# EAGLE schematic LG08.v1.0.2 (EAGLE 7.5.0)

## Sheet 1 of 6
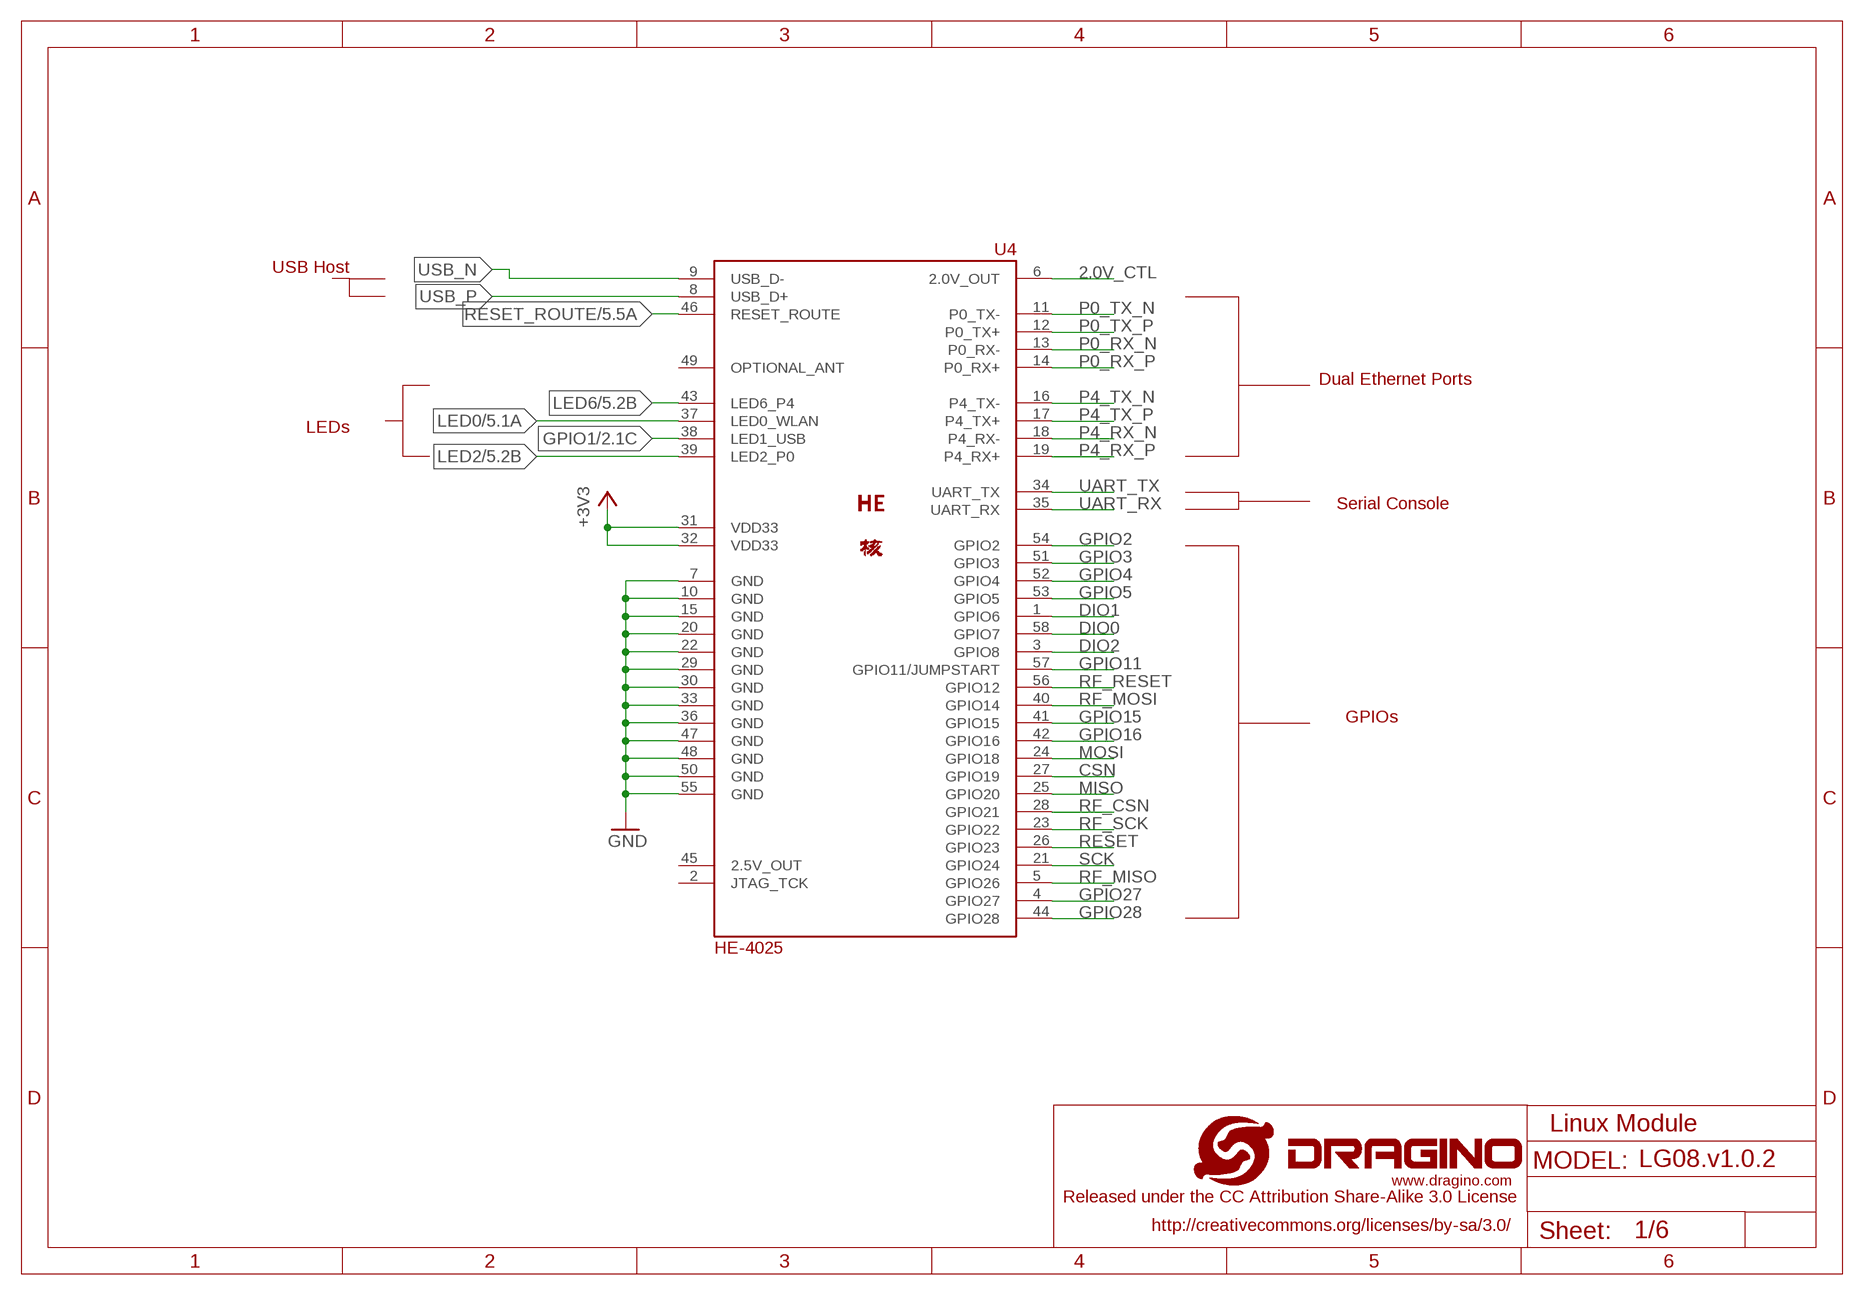
[diagram p0: schematic, sheet 1]

### Parts
U4  HE-4025  [HE-4025]

### Nets
2.0V_CTL: U4.6(2.0V_OUT) ; also sheet 4
+3V3: U4.31(VDD33) U4.32(VDD33) ; also sheet 2,4,5,6
CSN: U4.27(GPIO19) ; also sheet 5
DIO0: U4.58(GPIO7) ; also sheet 6
DIO1: U4.1(GPIO6) ; also sheet 6
DIO2: U4.3(GPIO8) ; also sheet 6
GND [gnd]: U4.7(GND) U4.10(GND) U4.15(GND) U4.20(GND) U4.22(GND) U4.29(GND) U4.30(GND) U4.33(GND) U4.36(GND) U4.47(GND) U4.48(GND) U4.50(GND) U4.55(GND) ; also sheet 2,3,4,5,6
GPIO1: U4.38(LED1_USB) ; also sheet 2
GPIO2: U4.54(GPIO2)
GPIO3: U4.51(GPIO3)
GPIO4: U4.52(GPIO4)
GPIO5: U4.53(GPIO5)
GPIO11: U4.57(GPIO11/JUMPSTART) ; also sheet 5
GPIO15: U4.41(GPIO15) ; also sheet 3
GPIO16: U4.42(GPIO16) ; also sheet 5
GPIO27: U4.4(GPIO27) ; also sheet 5
GPIO28: U4.44(GPIO28) ; also sheet 5
LED0: U4.37(LED0_WLAN) ; also sheet 5
LED2: U4.39(LED2_P0) ; also sheet 5
LED6: U4.43(LED6_P4) ; also sheet 5
MISO: U4.25(GPIO20) ; also sheet 5
MOSI: U4.24(GPIO18) ; also sheet 5
P0_RX_N: U4.13(P0_RX-) ; also sheet 4
P0_RX_P: U4.14(P0_RX+) ; also sheet 4
P0_TX_N: U4.11(P0_TX-) ; also sheet 4
P0_TX_P: U4.12(P0_TX+) ; also sheet 4
P4_RX_N: U4.18(P4_RX-) ; also sheet 4
P4_RX_P: U4.19(P4_RX+) ; also sheet 4
P4_TX_N: U4.16(P4_TX-) ; also sheet 4
P4_TX_P: U4.17(P4_TX+) ; also sheet 4
RESET: U4.26(GPIO23) ; also sheet 5
RESET_ROUTE: U4.46(RESET_ROUTE) ; also sheet 5
RF_CSN: U4.28(GPIO21) ; also sheet 6
RF_MISO: U4.5(GPIO26) ; also sheet 6
RF_MOSI: U4.40(GPIO14) ; also sheet 6
RF_RESET: U4.56(GPIO12) ; also sheet 6
RF_SCK: U4.23(GPIO22) ; also sheet 6
SCK: U4.21(GPIO24) ; also sheet 5
UART_RX: U4.35(UART_RX) ; also sheet 4
UART_TX: U4.34(UART_TX) ; also sheet 4
USB_N: U4.9(USB_D-) ; also sheet 6
USB_P: U4.8(USB_D+) ; also sheet 6
Unconnected: U4.2(JTAG_TCK) U4.45(2.5V_OUT)

### Notes on the sheet
- USB Host
- Dual Ethernet Ports
- LEDs
- Serial Console
- GPIOs
- Linux Module

## Sheet 2 of 6
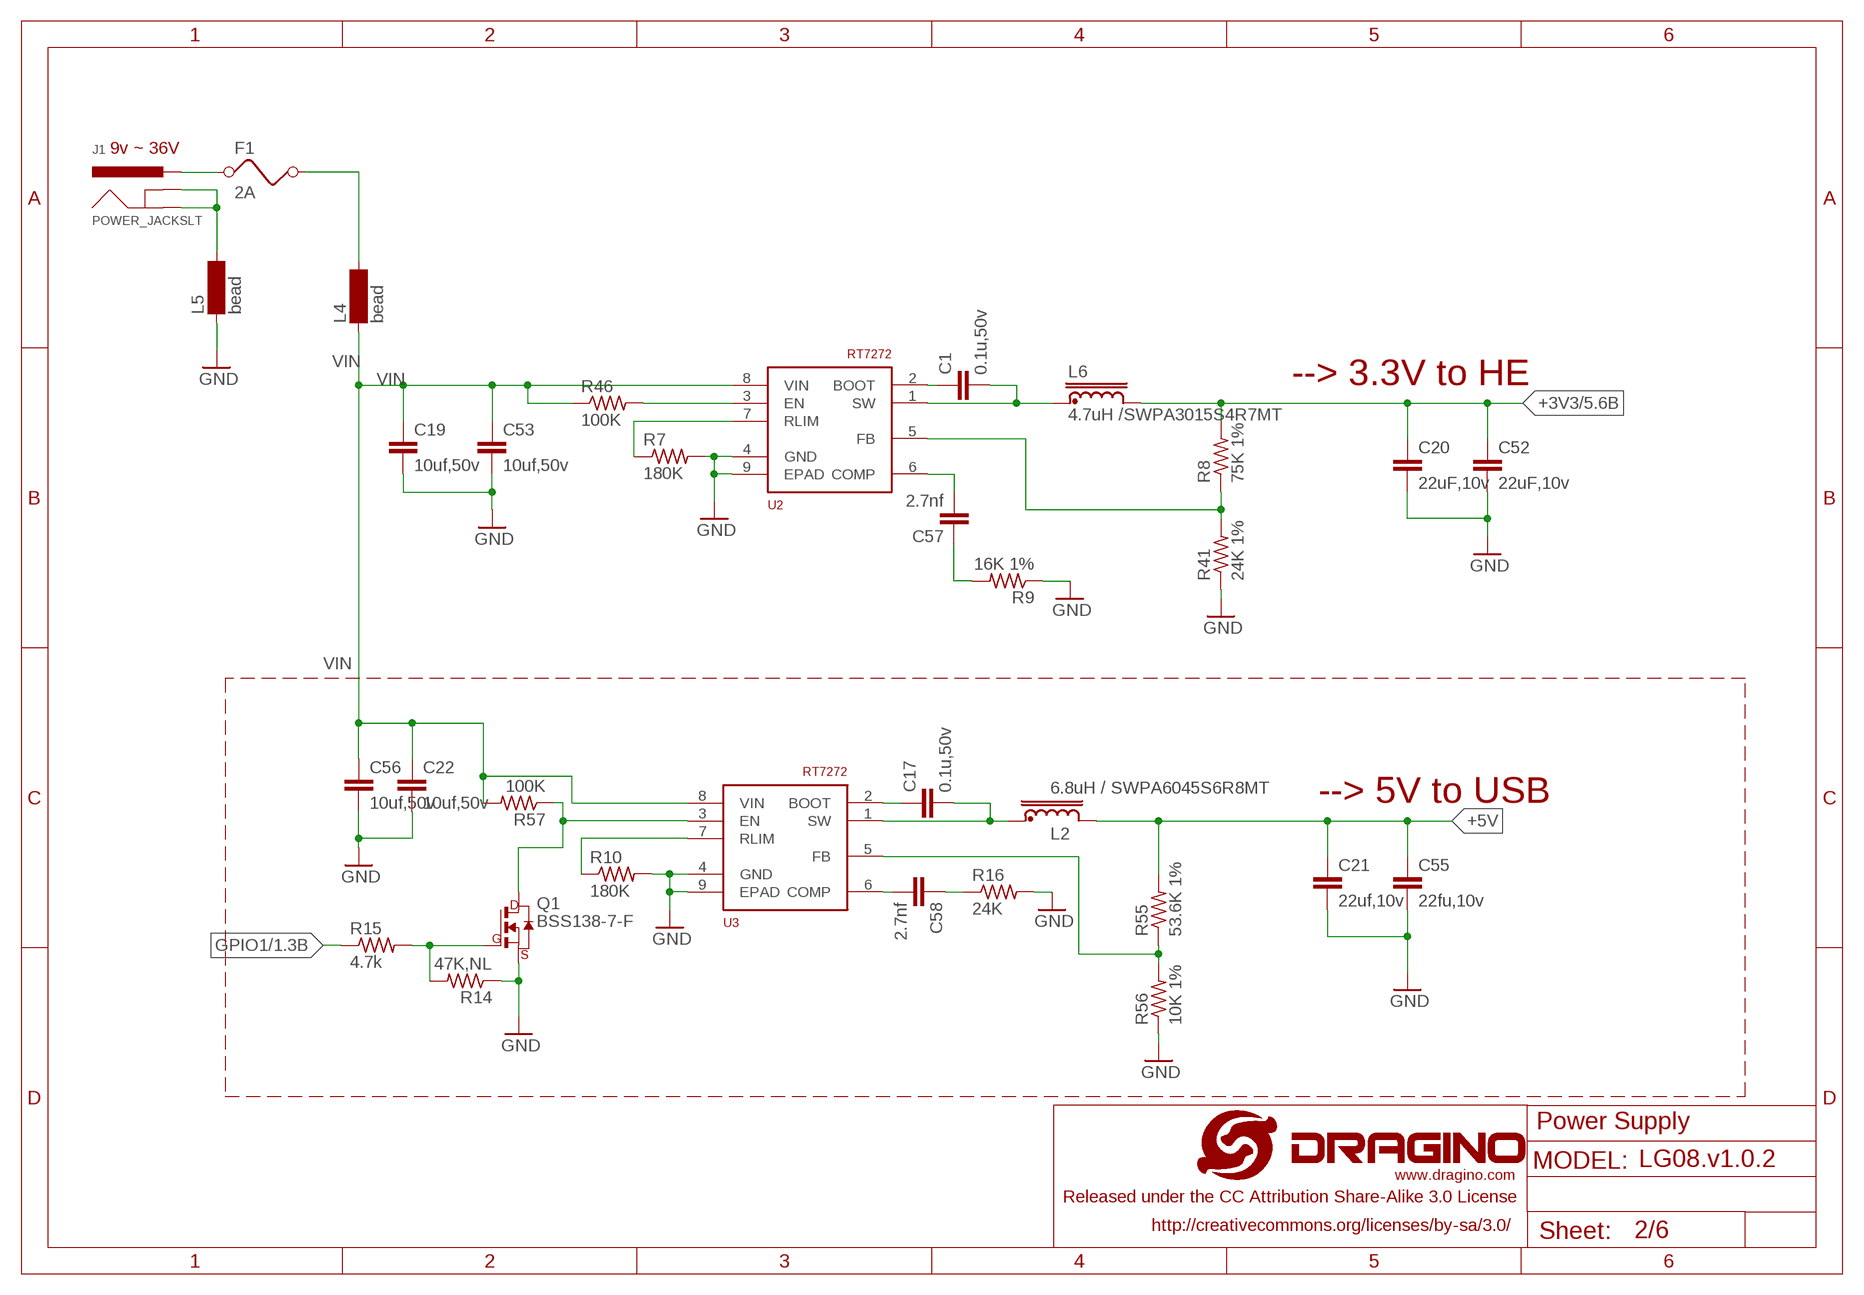
[diagram p1: schematic, sheet 2]

### Parts
C1  0.1u,50v  C-EUC0402  [C0402]
C17  0.1u,50v  C-EUC0402  [C0402]
C19  10uf,50v  C-EUC1206K  [C1206K]
C20  22uF,10v  C-EUC1210  [C1210]
C21  22uf,10v  C-EUC1210  [C1210]
C22  10uf,50v  C-EUC1206K  [C1206K]
C52  22uF,10v  C-EUC1210  [C1210]
C53  10uf,50v  C-EUC1206K  [C1206K]
C55  22fu,10v  C-EUC1210  [C1210]
C56  10uf,50v  C-EUC1206K  [C1206K]
C57  2.7nf  C-EUC0402  [C0402]
C58  2.7nf  C-EUC0402  [C0402]
F1  2A  FUSE1812  [L1812]
J1  POWER_JACKSLT  [POWER_JACK_SLOT]
L2  6.8uH / SWPA6045S6R8MT  INDUCTOR6028S  [SWPA6028S]
L4  bead  BS11  [BS11]
L5  bead  BS11  [BS11]
L6  4.7uH /SWPA3015S4R7MT  INDUCTORSWPA3010S  [SWPA3010S]
Q1  BSS138-7-F  NMOSFET  [SOT-23]
R7  180K  R-US_R0402  [R0402]
R8  75K 1%  R-US_R0402  [R0402]
R9  16K 1%  R-US_R0402  [R0402]
R10  180K  R-US_R0402  [R0402]
R14  47K,NL  R-US_R0402  [R0402]
R15  4.7k  R-US_R0402  [R0402]
R16  24K  R-US_R0402  [R0402]
R41  24K 1%  R-US_R0402  [R0402]
R46  100K  R-US_R0402  [R0402]
R55  53.6K 1%  R-US_R0402  [R0402]
R56  10K 1%  R-US_R0402  [R0402]
R57  100K  R-US_R0402  [R0402]
U2  RT7272  [RT8250-SOP8]
U3  RT7272  [RT8250-SOP8]

### Nets
+3V3: C20.1 C52.1 L6.P$2 R8.2 ; also sheet 1,4,5,6
+5V: C21.1 C55.1 L2.P$2 R55.2 ; also sheet 4,5,6
GND [gnd]: C19.2 C20.2 C21.2 C22.2 C52.2 C53.2 C55.2 C56.2 L5.1 Q1.2(S) R7.2 R9.1 R10.2 R14.1 R16.2 R41.1 R56.1 U2.4(GND) U2.9(EPAD) U3.4(GND) U3.9(EPAD) ; also sheet 1,3,4,5,6
GPIO1: R15.1 ; also sheet 1
N$2: J1.GND@1(GNDBREAK) J1.GND@2(GND) L5.2
N$3: F1.2 L4.2
N$12: F1.1 J1.PWR
N$16: Q1.1(D) R57.1 U3.3(EN)
N$17: R10.1 U3.7(RLIM)
N$19: Q1.3(G) R14.2 R15.2
N$20: C58.2 U3.6(COMP)
N$22 [gnd]: R55.1 R56.2 U3.5(FB)
N$24: C1.2 L6.P$1 U2.1(SW)
N$25: R46.2 U2.3(EN)
N$26: R7.1 U2.7(RLIM)
N$27: C1.1 U2.2(BOOT)
N$29: C57.1 R9.2
N$31: C57.2 U2.6(COMP)
N$32: C58.1 R16.1
N$34: C17.2 L2.P$1 U3.1(SW)
N$49: R8.1 R41.2 U2.5(FB)
N$55: C17.1 U3.2(BOOT)
VIN: C19.1 C22.1 C53.1 C56.1 L4.1 R46.1 R57.2 U2.8(VIN) U3.8(VIN) ; also sheet 3

### Notes on the sheet
- 9v ~ 36V
- --> 3.3V to HE
- --> 5V to USB
- Power Supply

## Sheet 3 of 6
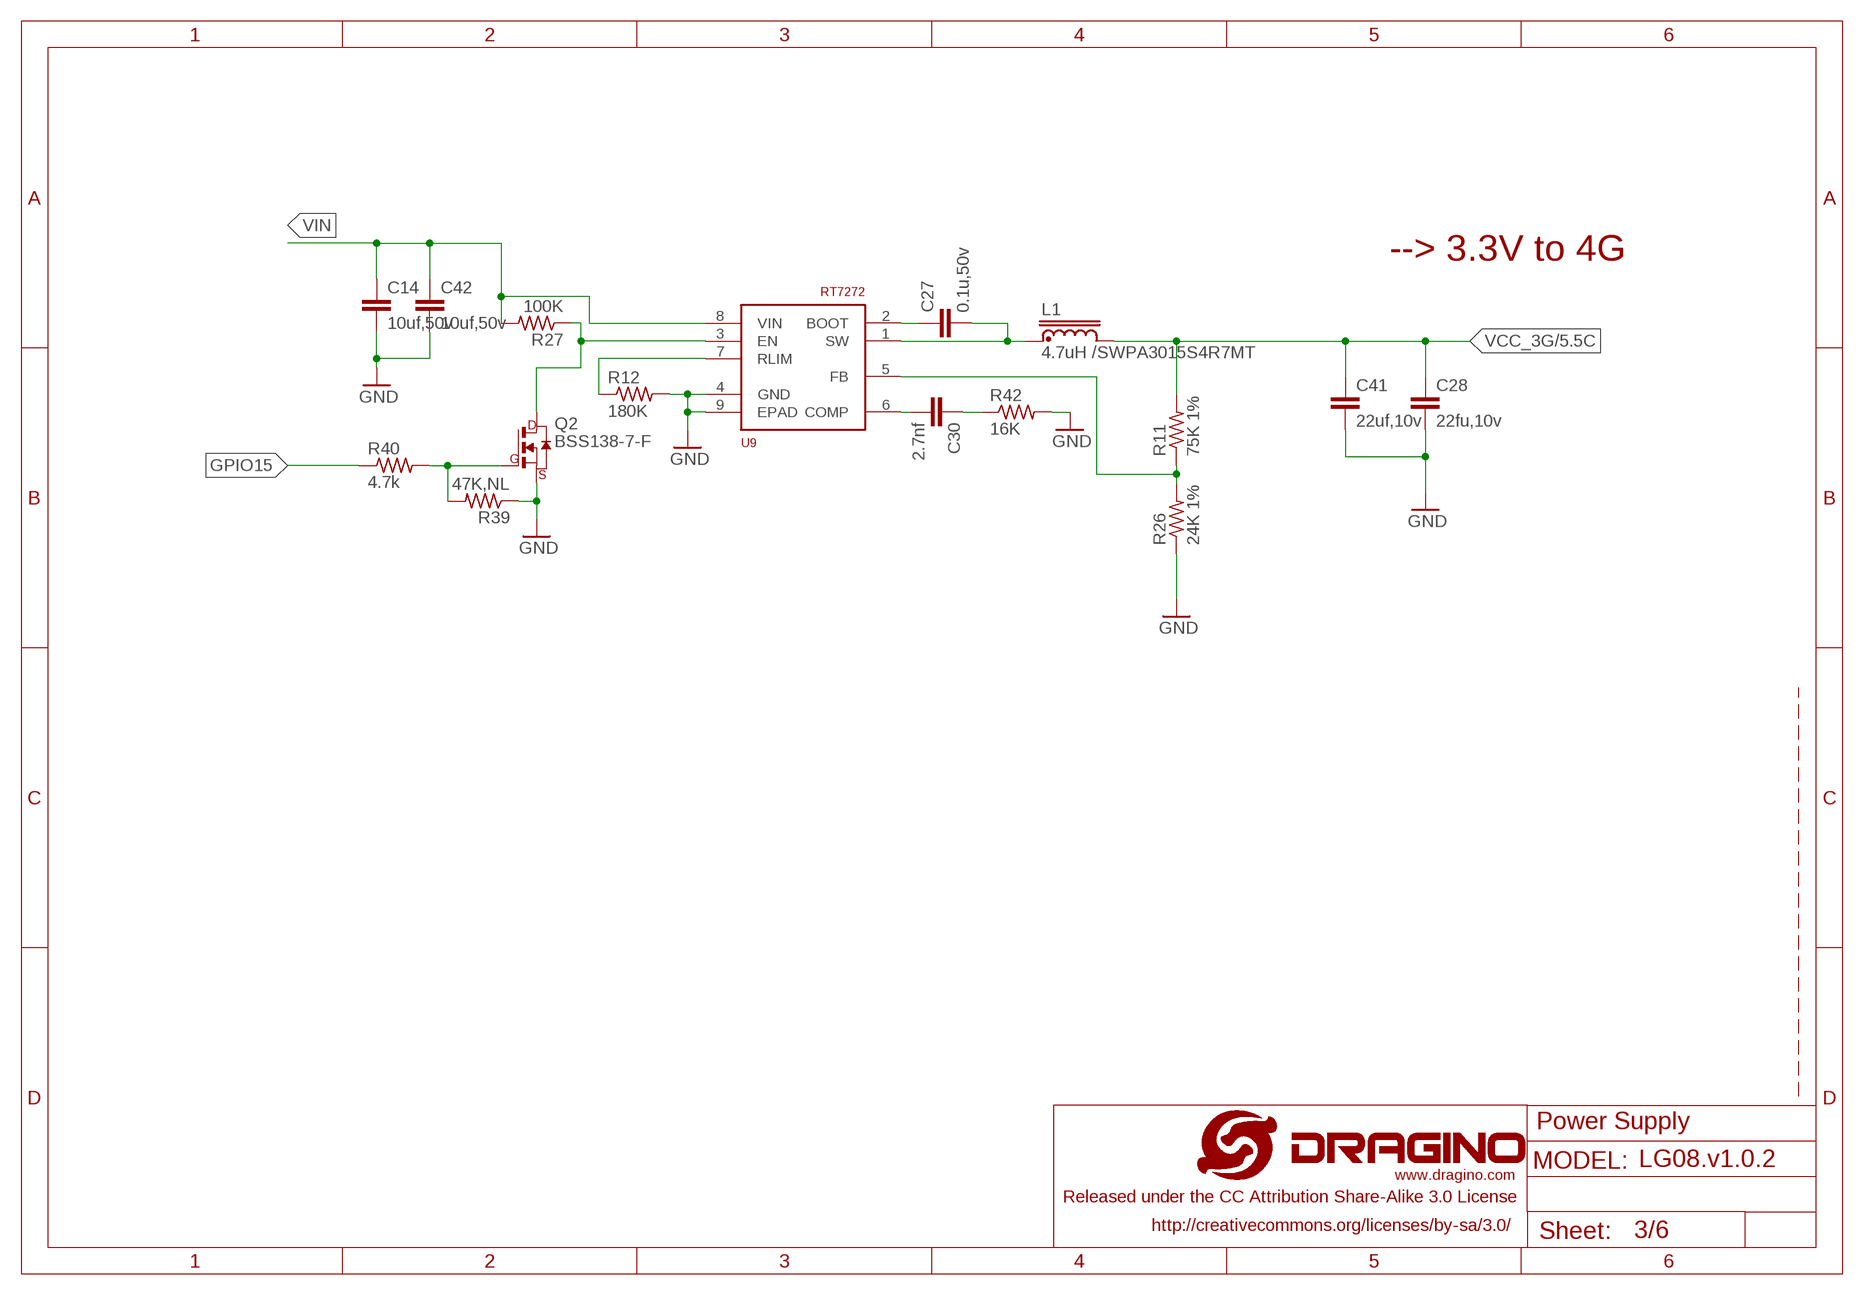
[diagram p2: schematic, sheet 3]

### Parts
C14  10uf,50v  C-EUC1206K  [C1206K]
C27  0.1u,50v  C-EUC0402  [C0402]
C28  22fu,10v  C-EUC1210  [C1210]
C30  2.7nf  C-EUC0402  [C0402]
C41  22uf,10v  C-EUC1210  [C1210]
C42  10uf,50v  C-EUC1206K  [C1206K]
L1  4.7uH /SWPA3015S4R7MT  INDUCTORSWPA3010S  [SWPA3010S]
Q2  BSS138-7-F  NMOSFET  [SOT-23]
R11  75K 1%  R-US_R0402  [R0402]
R12  180K  R-US_R0402  [R0402]
R26  24K 1%  R-US_R0402  [R0402]
R27  100K  R-US_R0402  [R0402]
R39  47K,NL  R-US_R0402  [R0402]
R40  4.7k  R-US_R0402  [R0402]
R42  16K  R-US_R0402  [R0402]
U9  RT7272  [RT8250-SOP8]

### Nets
GND [gnd]: C14.2 C28.2 C41.2 C42.2 Q2.2(S) R12.2 R26.1 R39.1 R42.2 U9.4(GND) U9.9(EPAD) ; also sheet 1,2,4,5,6
GPIO15: R40.1 ; also sheet 1
N$56 [gnd]: R11.1 R26.2 U9.5(FB)
N$63: Q2.1(D) R27.1 U9.3(EN)
N$64: R12.1 U9.7(RLIM)
N$65: Q2.3(G) R39.2 R40.2
N$66: C30.2 U9.6(COMP)
N$67: C30.1 R42.1
N$68: C27.2 L1.P$1 U9.1(SW)
N$69: C27.1 U9.2(BOOT)
VCC_3G: C28.1 C41.1 L1.P$2 R11.2 ; also sheet 5
VIN: C14.1 C42.1 R27.2 U9.8(VIN) ; also sheet 2

### Notes on the sheet
- --> 3.3V to 4G
- Power Supply

## Sheet 4 of 6
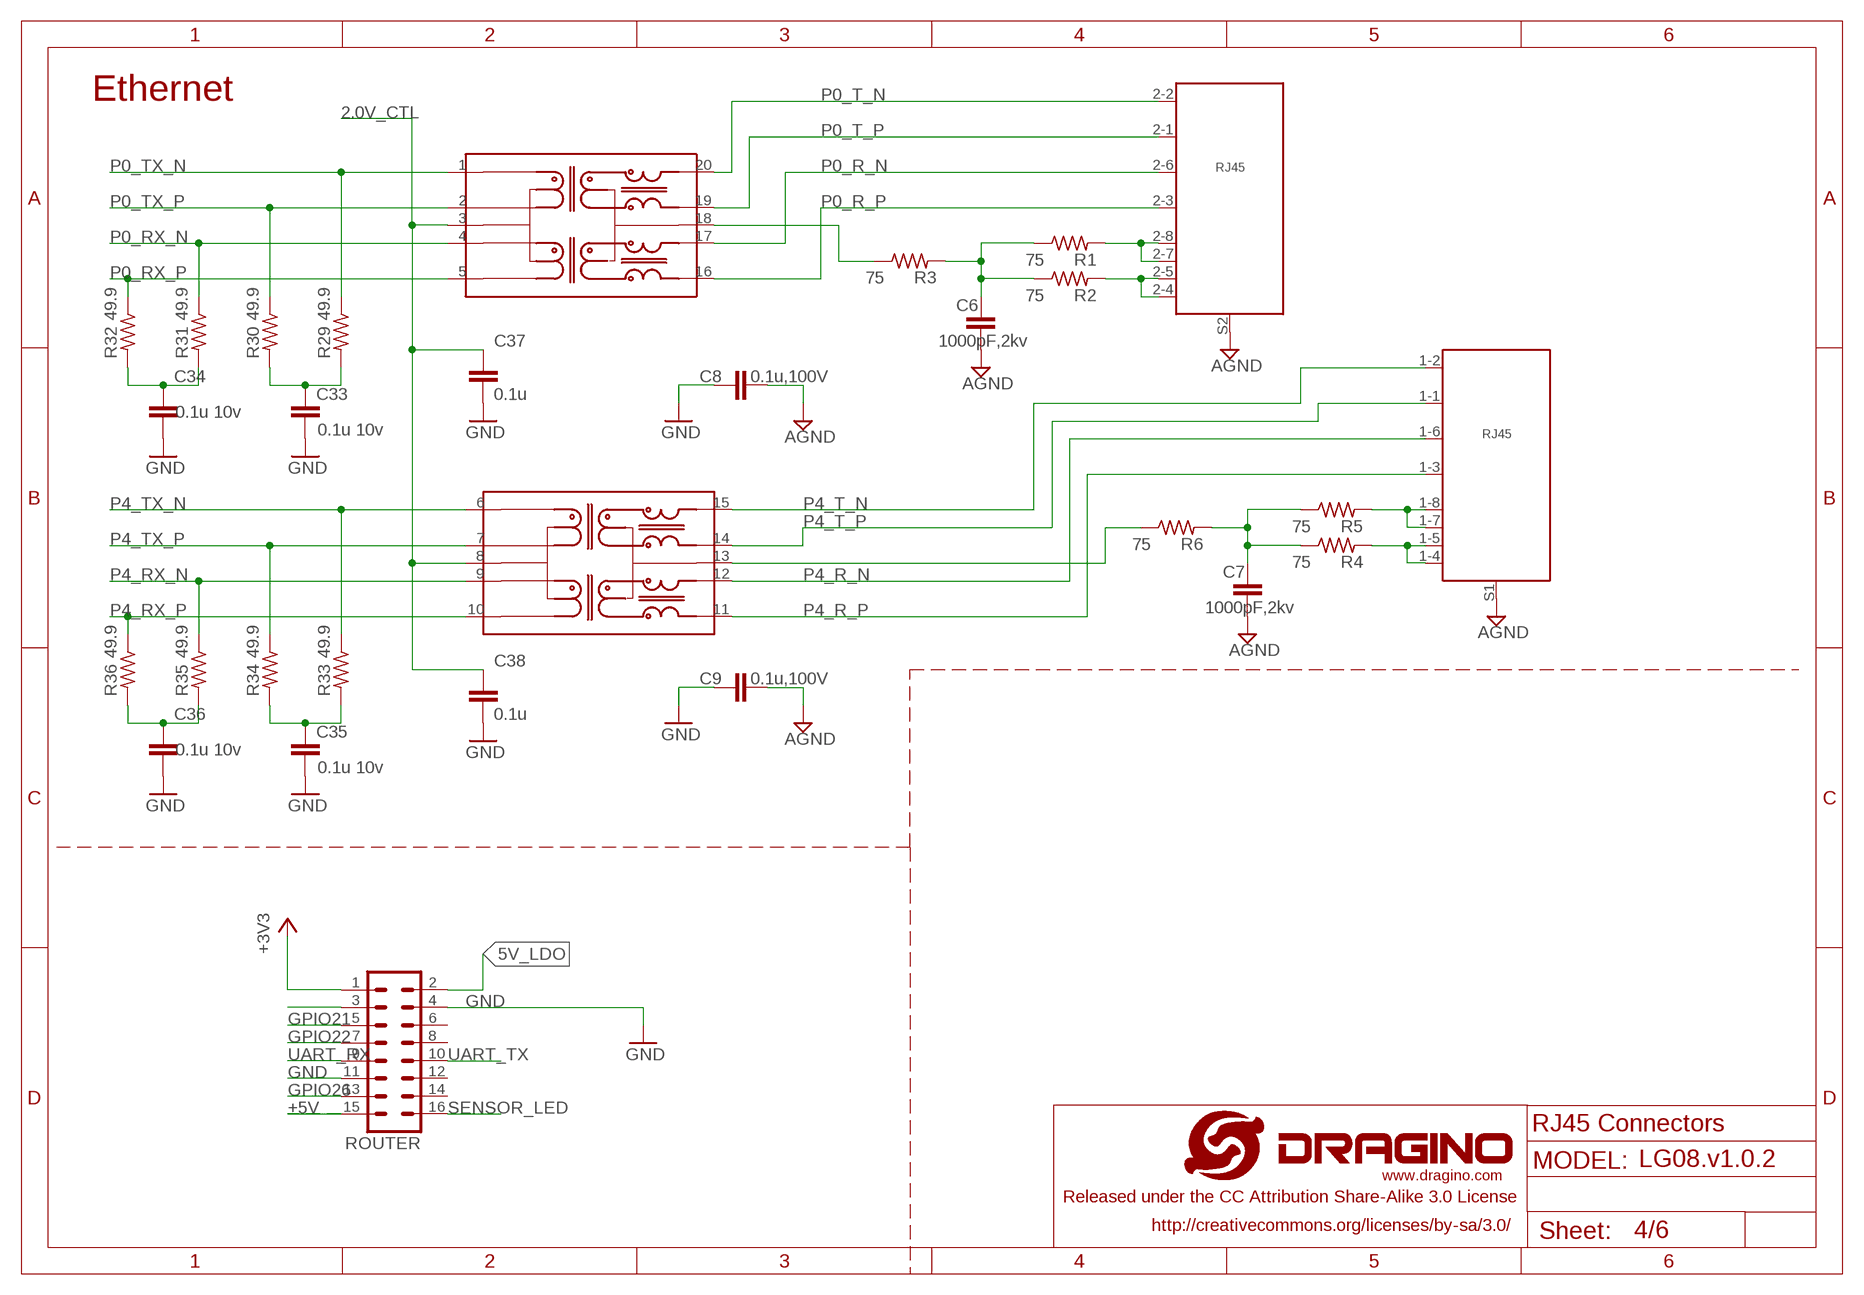
[diagram p3: schematic, sheet 4]

### Parts
C6  1000pF,2kv  C-EUC1206  [C1206]
C7  1000pF,2kv  C-EUC1206  [C1206]
C8  0.1u,100V  C-EUC0805  [C0805]
C9  0.1u,100V  C-EUC0805  [C0805]
C33  0.1u 10v  C-EUC0402  [C0402]
C34  0.1u 10v  C-EUC0402  [C0402]
C35  0.1u 10v  C-EUC0402  [C0402]
C36  0.1u 10v  C-EUC0402  [C0402]
C37  0.1u  C-EUC0402  [C0402]
C38  0.1u  C-EUC0402  [C0402]
J2  ETHERNET_2PORT  [ETHERNET-1X2]
R1  75  R-US_R0402  [R0402]
R2  75  R-US_R0402  [R0402]
R3  75  R-US_R0402  [R0402]
R4  75  R-US_R0402  [R0402]
R5  75  R-US_R0402  [R0402]
R6  75  R-US_R0402  [R0402]
R29  49.9  R-US_R0402  [R0402]
R30  49.9  R-US_R0402  [R0402]
R31  49.9  R-US_R0402  [R0402]
R32  49.9  R-US_R0402  [R0402]
R33  49.9  R-US_R0402  [R0402]
R34  49.9  R-US_R0402  [R0402]
R35  49.9  R-US_R0402  [R0402]
R36  49.9  R-US_R0402  [R0402]
ROUTER  MA08-2  [MA08-2]
T1  RJ45_TRANSFORMER_HST2038DR  [RIONET_H2038]

### Nets
2.0V_CTL: C37.1 C38.1 T1.3(CT1) T1.8(CT1) ; also sheet 1
5V_LDO: ROUTER.2
+3V3: ROUTER.1 ; also sheet 1,2,5,6
+5V: ROUTER.15 ; also sheet 2,5,6
AGND: C6.2 C7.2 C8.2 C9.2 J2.S1(SHIELD) J2.S2(SHIELD)
GND [gnd]: C8.1 C9.1 C33.2 C34.2 C35.2 C36.2 C37.2 C38.2 ROUTER.4 ROUTER.11 ; also sheet 1,2,3,5,6
GPIO21: ROUTER.5
GPIO22: ROUTER.7
GPIO26: ROUTER.13
N$7: R6.1 T1.13(CT2)
N$39: C35.1 R33.2 R34.2
N$40: C36.1 R35.2 R36.2
N$41: J2.2-7 J2.2-8 R1.2
N$42: J2.2-4 J2.2-5 R2.2
N$43: C33.1 R29.2 R30.2
N$44: C34.1 R31.2 R32.2
N$45: R3.1 T1.18(CT2)
N$46: C6.1 R1.1 R2.1 R3.2
N$51: J2.1-7 J2.1-8 R5.2
N$52: J2.1-4 J2.1-5 R4.2
N$54: C7.1 R4.1 R5.1 R6.2
P0_R_N: J2.2-6 T1.17(RX+)
P0_R_P: J2.2-3 T1.16(RX-)
P0_RX_N: R31.1 T1.4(RD+) ; also sheet 1
P0_RX_P: R32.1 T1.5(RD-) ; also sheet 1
P0_T_N: J2.2-2 T1.20(TX+)
P0_T_P: J2.2-1 T1.19(TX-)
P0_TX_N: R29.1 T1.1(TD+) ; also sheet 1
P0_TX_P: R30.1 T1.2(TD-) ; also sheet 1
P4_R_N: J2.1-6 T1.12(RX+)
P4_R_P: J2.1-3 T1.11(RX-)
P4_RX_N: R35.1 T1.9(RD+) ; also sheet 1
P4_RX_P: R36.1 T1.10(RD-) ; also sheet 1
P4_T_N: J2.1-2 T1.15(TX+)
P4_T_P: J2.1-1 T1.14(TX-)
P4_TX_N: R33.1 T1.6(TD+) ; also sheet 1
P4_TX_P: R34.1 T1.7(TD-) ; also sheet 1
RESET_ROUTE1: ROUTER.3
SENSOR_LED: ROUTER.16
UART_RX: ROUTER.9 ; also sheet 1
UART_TX: ROUTER.10 ; also sheet 1
Unconnected: ROUTER.6 ROUTER.8 ROUTER.12 ROUTER.14

### Notes on the sheet
- Ethernet
- RJ45 Connectors

## Sheet 5 of 6
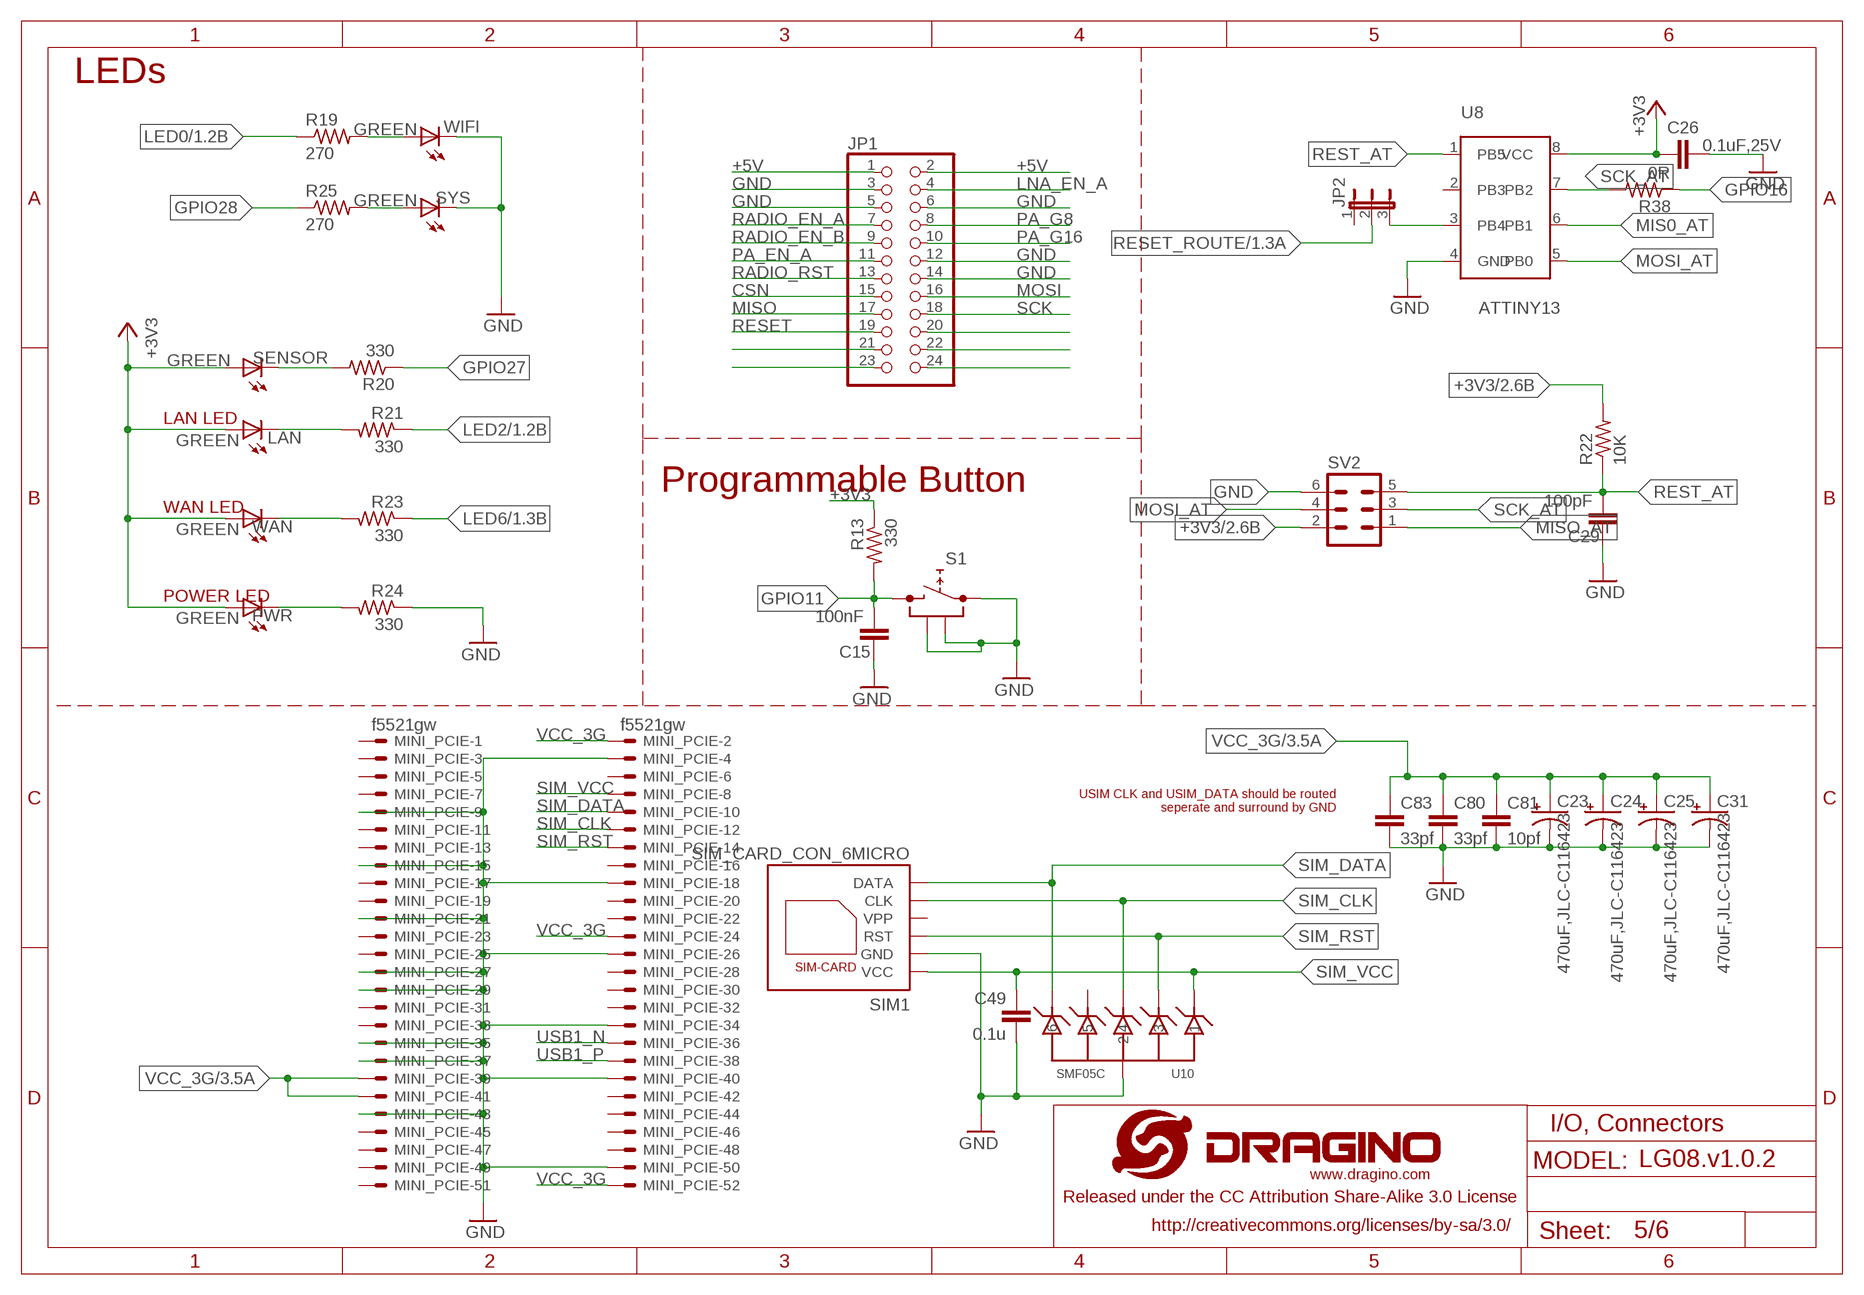
[diagram p4: schematic, sheet 5]

### Parts
C15  100nF  C-EUC0402  [C0402]
C23  470uF,JLC-C116423  CPOL-USUD-6,3X5,8  [UD-6,3X5,8_NICHICON]
C24  470uF,JLC-C116423  CPOL-USUD-6,3X5,8  [UD-6,3X5,8_NICHICON]
C25  470uF,JLC-C116423  CPOL-USUD-6,3X5,8  [UD-6,3X5,8_NICHICON]
C26  0.1uF,25V  C-EUC0402  [C0402]
C29  100pF  C-EUC0402  [C0402]
C31  470uF,JLC-C116423  CPOL-USUD-6,3X5,8  [UD-6,3X5,8_NICHICON]
C49  0.1u  C-EUC0402  [C0402]
C80  33pf  C-EUC0402  [C0402]
C81  10pf  C-EUC0402  [C0402]
C83  33pf  C-EUC0402  [C0402]
JP1  PINHD-2X12  [2X12]
JP2  JP2E  [JP2]
LAN  GREEN  LED3MM  [LED3MM]
MINI_PCIE  f5521gw  MINI-PCI-E-F  [679105700]
PWR  GREEN  LED3MM  [LED3MM]
R13  330  R-US_R0402  [R0402]
R19  270  R-US_R0402  [R0402]
R20  330  R-US_R0402  [R0402]
R21  330  R-US_R0402  [R0402]
R22  10K  R-US_R0402  [R0402]
R23  330  R-US_R0402  [R0402]
R24  330  R-US_R0402  [R0402]
R25  270  R-US_R0402  [R0402]
R38  0R  R-US_R0402  [R0402]
S1  PUSH_SWITCH  [SWITCH_6X6X5]
SENSOR  GREEN  LED3MM  [LED3MM]
SIM1  SIM_CARD_CON_6MICRO  [SIM-MICRO-PUSH]
SV2  MA03-2  [MA03-2]
SYS  GREEN  LED3MM  [LED3MM]
U8  ATTINY13  [S8S1]
U10  SMF05C  [SOT363]
WAN  GREEN  LED3MM  [LED3MM]
WIFI  GREEN  LED3MM  [LED3MM]

### Nets
+3V3: C26.2 LAN.A PWR.A R13.1 R22.2 SENSOR.A SV2.2 U8.8(VCC) WAN.A ; also sheet 1,2,4,6
+5V: JP1.1 JP1.2 ; also sheet 2,4,6
CSN: JP1.15 ; also sheet 1
GND [gnd]: C15.1 C23.- C24.- C25.- C26.1 C29.1 C31.- C49.2 C80.2 C81.2 C83.2 JP1.3 JP1.5 JP1.6 JP1.12 JP1.14 MINI_PCIE.4 MINI_PCIE.9 MINI_PCIE.15 MINI_PCIE.18 MINI_PCIE.21 MINI_PCIE.26 MINI_PCIE.27 MINI_PCIE.29 MINI_PCIE.34 MINI_PCIE.35 MINI_PCIE.37 MINI_PCIE.40 MINI_PCIE.43 MINI_PCIE.50 R24.1 S1.1 S1.3 S1.4 SIM1.GND SIM1.P$1(GND) SIM1.P$2(GND) SIM1.P$3(GND) SIM1.P$4(GND) SV2.6 SYS.K(C) U8.4(GND) U10.2 WIFI.K(C) ; also sheet 1,2,3,4,6
GPIO11: C15.2 R13.2 S1.2 ; also sheet 1
GPIO16: R38.1 ; also sheet 1
GPIO27: R20.1 ; also sheet 1
GPIO28: R25.1 ; also sheet 1
LED0: R19.1 ; also sheet 1
LED2: R21.1 ; also sheet 1
LED6: R23.1 ; also sheet 1
LNA_EN_A: JP1.4
MIS0_AT: U8.6(PB1)
MISO: JP1.17 ; also sheet 1
MISO_AT: SV2.1
MOSI: JP1.16 ; also sheet 1
MOSI_AT: SV2.4 U8.5(PB0)
N$1: R25.2 SYS.A
N$4: JP2.3 U8.3(PB4)
N$6: JP1.21
N$8: JP1.23
N$9: JP1.20
N$10: JP1.22
N$11: JP1.24
N$13: R20.2 SENSOR.K(C)
N$23: R19.2 WIFI.A
N$30: LAN.K(C) R21.2
N$35: PWR.K(C) R24.2
PA_EN_A: JP1.11
PA_G8: JP1.8
PA_G16: JP1.10
RADIO_EN_A: JP1.7
RADIO_EN_B: JP1.9
RADIO_RST: JP1.13
RESET: JP1.19 ; also sheet 1
RESET_ROUTE: JP2.2 ; also sheet 1
REST_AT: C29.2 R22.1 SV2.5 U8.1(PB5)
SCK: JP1.18 ; also sheet 1
SCK_AT: R38.2 SV2.3 U8.7(PB2)
SIM_CLK: MINI_PCIE.12 SIM1.CLK U10.4
SIM_DATA: MINI_PCIE.10 SIM1.IO(DATA) U10.6
SIM_RST: MINI_PCIE.14 SIM1.RST U10.3
SIM_VCC: C49.1 MINI_PCIE.8 SIM1.VCC U10.1
USB1_N: MINI_PCIE.36 ; also sheet 6
USB1_P: MINI_PCIE.38 ; also sheet 6
VCC_3G: C23.+ C24.+ C25.+ C31.+ C80.1 C81.1 C83.1 MINI_PCIE.2 MINI_PCIE.24 MINI_PCIE.39 MINI_PCIE.41 MINI_PCIE.52 ; also sheet 3
YELLOW: R23.2 WAN.K(C)
Unconnected: JP2.1 MINI_PCIE.1 MINI_PCIE.3 MINI_PCIE.5 MINI_PCIE.6 MINI_PCIE.7 MINI_PCIE.11 MINI_PCIE.13 MINI_PCIE.16 MINI_PCIE.17 MINI_PCIE.19 MINI_PCIE.20 MINI_PCIE.22 MINI_PCIE.23 MINI_PCIE.25 MINI_PCIE.28 MINI_PCIE.30 MINI_PCIE.31 MINI_PCIE.32 MINI_PCIE.33 MINI_PCIE.42 MINI_PCIE.44 MINI_PCIE.45 MINI_PCIE.46 MINI_PCIE.47 MINI_PCIE.48 MINI_PCIE.49 MINI_PCIE.51 SIM1.VPP U8.2(PB3) U10.5

### Notes on the sheet
- LEDs
- LAN LED
- Programmable Button
- WAN LED
- POWER LED
- USIM CLK and USIM_DATA should be routed
  seperate and surround by GND
- I/O, Connectors

## Sheet 6 of 6
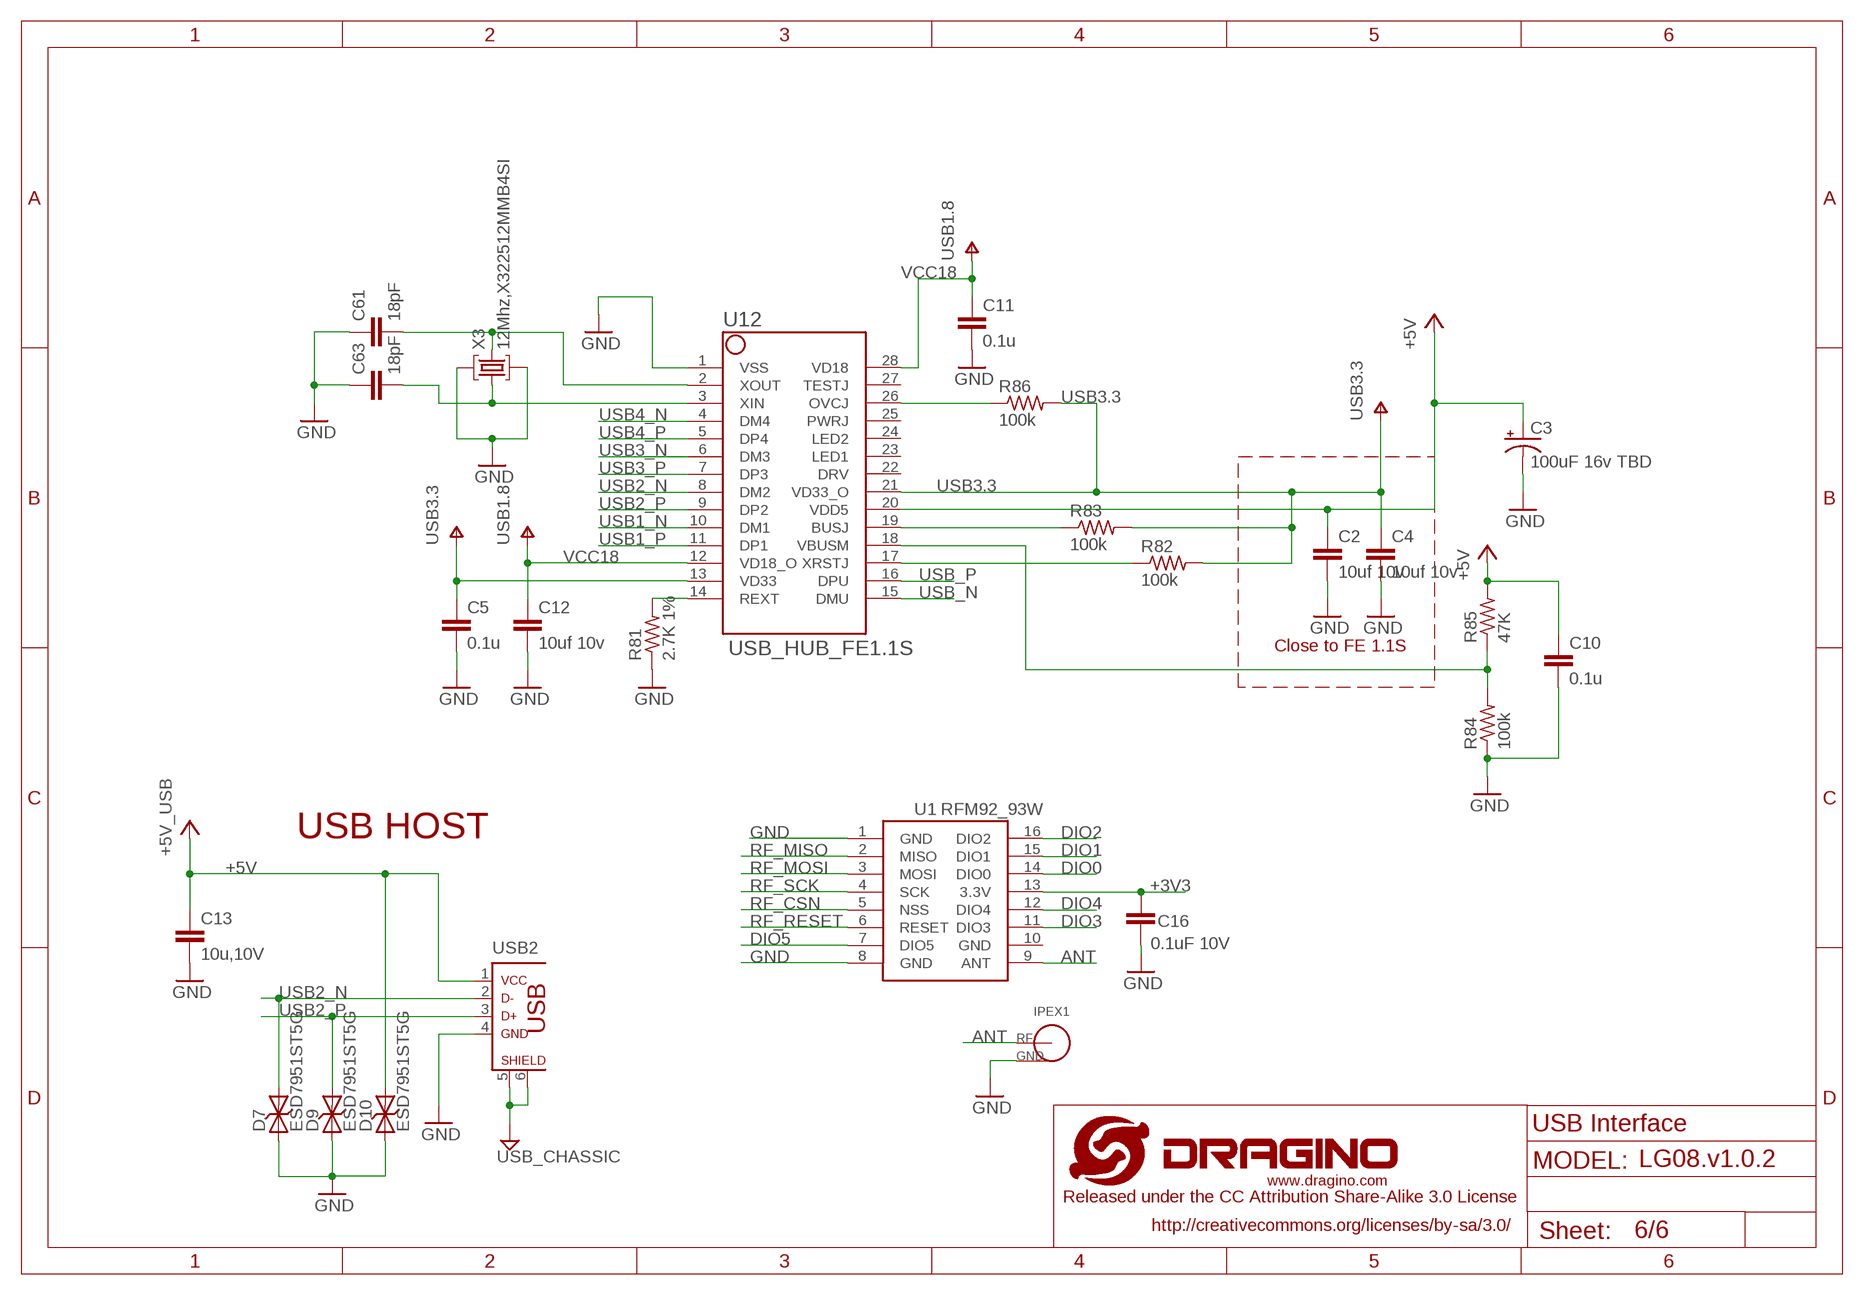
[diagram p5: schematic, sheet 6]

### Parts
C2  10uf 10v  C-EUC0603  [C0603]
C3  100uF 16v TBD  CPOL-USUD-6,3X5,8  [UD-6,3X5,8_NICHICON]
C4  10uf 10v  C-EUC0603  [C0603]
C5  0.1u  C-EUC0402  [C0402]
C10  0.1u  C-EUC0402  [C0402]
C11  0.1u  C-EUC0402  [C0402]
C12  10uf 10v  C-EUC0603  [C0603]
C13  10u,10V  C-EUC0805  [C0805]
C16  0.1uF 10V  C-EUC0402  [C0402]
C61  18pF  C-EUC0402  [C0402]
C63  18pF  C-EUC0402  [C0402]
D7  ESD7951ST5G  TVSSOD−923  [SOD−923]
D9  ESD7951ST5G  TVSSOD−923  [SOD−923]
D10  ESD7951ST5G  TVSSOD−923  [SOD−923]
IPEX1  I-PEX  [I-PEX]
R81  2.7K 1%  R-US_R0402  [R0402]
R82  100k  R-US_R0402  [R0402]
R83  100k  R-US_R0402  [R0402]
R84  100k  R-US_R0402  [R0402]
R85  47K  R-US_R0402  [R0402]
R86  100k  R-US_R0402  [R0402]
U1  RFM92_93W  [RFM92_93W]
U12  USB_HUB_FE1.1S  [USB_HUB_FE1.1S]
USB2  USB_C42562  [USB_C42562]
X3  12Mhz,X322512MMB4SI  CRYSTAL  [SMARTPRJ_CRYSTAL-3.2-2.5]

### Nets
+3V3: C16.2 U1.13(3.3V) ; also sheet 1,2,4,5
+5V: C2.1 C3.+ C10.1 C13.1 D10.P$2 R85.2 U12.20(VDD5) USB2.1 ; supply symbol labelled +5V_USB ; also sheet 2,4,5
ANT [2layer-50ohm]: IPEX1.SIG U1.9(ANT)
CLK_N: C63.2 U12.3(XIN) X3.1(C1)
CLK_P: C61.2 U12.2(XOUT) X3.3(C2)
DIO0: U1.14(DIO0) ; also sheet 1
DIO1: U1.15(DIO1) ; also sheet 1
DIO2: U1.16(DIO2) ; also sheet 1
DIO3: U1.11(DIO3)
DIO4: U1.12(DIO4)
DIO5: U1.7(DIO5)
GND [gnd]: C2.2 C3.- C4.2 C5.2 C10.2 C11.2 C12.2 C13.2 C16.1 C61.1 C63.1 D7.P$1 D9.P$1 D10.P$1 IPEX1.GND IPEX1.GND1(GND) R81.1 R84.1 U1.1(GND) U1.8(GND) U12.1(VSS) USB2.4 X3.2(GND) X3.4(GND) ; also sheet 1,2,3,4,5
N$18: R86.1 U12.26(OVCJ)
N$109: R81.2 U12.14(REXT)
N$111: R82.1 U12.17(XRSTJ)
N$112: R83.1 U12.19(BUSJ)
N$113: R84.2 R85.1 U12.18(VBUSM)
RF_CSN: U1.5(NSS) ; also sheet 1
RF_MISO: U1.2(MISO) ; also sheet 1
RF_MOSI: U1.3(MOSI) ; also sheet 1
RF_RESET: U1.6(RESET) ; also sheet 1
RF_SCK: U1.4(SCK) ; also sheet 1
USB1_N: U12.10(DM1) ; also sheet 5
USB1_P: U12.11(DP1) ; also sheet 5
USB2_N [usbtrace-4layer]: D7.P$2 U12.8(DM2) USB2.2
USB2_P [usbtrace-4layer]: D9.P$2 U12.9(DP2) USB2.3
USB3.3: C4.1 C5.1 R82.2 R83.2 R86.2 U12.13(VD33) U12.21(VD33_O)
USB3_N: U12.6(DM3)
USB3_P: U12.7(DP3)
USB4_N: U12.4(DM4)
USB4_P: U12.5(DP4)
USB_GND [gnd]: USB2.5 USB2.6 ; supply symbol labelled USB_CHASSIC
USB_N: U12.15(DMU) ; also sheet 1
USB_P: U12.16(DPU) ; also sheet 1
VCC18: C11.1 C12.1 U12.12(VD18_O) U12.28(VD18) ; supply symbol labelled USB1.8
Unconnected: U12.22(DRV) U12.23(LED1) U12.24(LED2) U12.25(PWRJ) U12.27(TESTJ)

### Notes on the sheet
- Close to FE 1.1S
- USB HOST
- USB Interface

## Power pins joined to a net without a drawn wire
GND: U1.10(GND)
OPTIONAL_ANT: U4.49(OPTIONAL_ANT)

## Library data of the parts
C1 C6-C9 C13-C15 C17 C19-C22 C26-C30 C33-C38 C41 C42 C49 C52 C53 C55-C58 = dragino:C-EU: CAPACITOR, European symbol
C2 C4 C5 C10-C12 C16 C61 C63 C80 C81 C83 = dragino-passive:C-EU: CAPACITOR, European symbol
C3 C23-C25 C31 = dragino:CPOL-US: POLARIZED CAPACITOR, American symbol
D7 D9 D10 = dragino:TVS: DIODE
F1 = dragino:FUSE: FUSE 5 x 20 mm
IPEX1 = dragino-passive:I-PEX: I-PEX, U.F.L connector
J1 = dragino:POWER_JACK: Power Jack This is the standard 5.5mm barrel jack for power. The PTH is the most common, proven, reliable, footprint. All others are experimental. The Slot footprint only works if the mill layer is transmitted to the PCB fab house so be warned. Spark Fun Electronics SKU : PRT-00119. Mating wall wart : TOL-00298 (and others)
J2 = dragino:ETHERNET_2PORT
JP1 = pinhead:PINHD-2X12: PIN HEADER
JP2 = dragino:JP2E: JUMPER
L1 L6 = dragino:INDUCTOR: CHOKE U15
L2 = dragino-passive:INDUCTOR: CHOKE U15
L4 L5 = inductor-neosid:BS: INDUCTOR nominal inductance, magnetically screened; OC_FARNELL: unknown; OC_NEWARK: unknown
LAN PWR SENSOR SYS WAN WIFI = led:LED: LED OSRAM: - CHIPLED LG R971, LG N971, LY N971, LG Q971, LY Q971, LO R971, LY R971 LH N974, LH R974 LS Q976, LO Q976, LY Q976 LO Q996 - Hyper CHIPLED LW Q18S LB Q993, LB Q99A, LB R99A - SideLED LS A670, LO A670, LY A670, LG A670, LP A670 LB A673, LV A673, LT A673, LW A673 LH A674 LY A675 LS A676, LA A676, LO A676, LY A676, LW A676 LS A679, LY A679, LG A679 - Hyper Micro SIDELED® LS Y876, LA Y876, LO Y876, LY Y876 LT Y87S - SmartLED LW L88C, LW L88S LB L89C, LB L89S, LG L890 LS L89K, LO L89K, LY L89K LS L896, LA L896, LO L896, LY L896 - TOPLED LS T670, LO T670, LY T670, LG T670, LP T670 LSG T670, LSP T670, LSY T670, LOP T670, LYG T670 LG T671, LOG T671, LSG T671 LB T673, LV T673, LT T673, LW T673 LH T674 LS T676, LA T676, LO T676, LY T676, LB T676, LH T676, LSB T676, LW T676 LB T67C, LV T67C, LT T67C, LS T67K, LO T67K, LY T67K, LW E67C LS E67B, LA E67B, LO E67B, LY E67B, LB E67C, LV E67C, LT E67C LW T67C LS T679, LY T679, LG T679 LS T770, LO T770, LY T770, LG T770, LP T770 LB T773, LV T773, LT T773, LW T773 LH T774 LS E675, LA E675, LY E675, LS T675 LS T776, LA T776, LO T776, LY T776, LB T776 LHGB T686 LT T68C, LB T68C - Hyper Mini TOPLED® LB M676 - Mini TOPLED Santana® LG M470 LS M47K, LO M47K, LY M47K Source: http://www.osram.convergy.de LUXEON: - LUMILED® LXK2-PW12-R00, LXK2-PW12-S00, LXK2-PW14-U00, LXK2-PW14-V00 LXK2-PM12-R00, LXK2-PM12-S00, LXK2-PM14-U00 LXK2-PE12-Q00, LXK2-PE12-R00, LXK2-PE12-S00, LXK2-PE14-T00, LXK2-PE14-U00 LXK2-PB12-K00, LXK2-PB12-L00, LXK2-PB12-M00, LXK2-PB14-N00, LXK2-PB14-P00, LXK2-PB14-Q00 LXK2-PR12-L00, LXK2-PR12-M00, LXK2-PR14-Q00, LXK2-PR14-R00 LXK2-PD12-Q00, LXK2-PD12-R00, LXK2-PD12-S00 LXK2-PH12-R00, LXK2-PH12-S00 LXK2-PL12-P00, LXK2-PL12-Q00, LXK2-PL12-R00 Source: www.luxeon.com KINGBRIGHT: KA-3528ASYC Source: www.kingbright.com
MINI_PCIE = dragino:MINI-PCI-E-F: MINI PCI EXPRESS CONNECTOR 0.8MM PITCH, 52 CIRCUIT Source: http://www.molex.com/pdm_docs/sd/679105700_sd.pdf; MPN: 67910-5700; OC_FARNELL: unknown; OC_NEWARK: 93M2128
Q1 Q2 = dragino:NMOSFET: MOS FET; OC_FARNELL: unknown; OC_NEWARK: unknown
R1-R16 R19-R27 R29-R36 R38-R42 R46 R55-R57 R81-R86 = dragino:R-US_: RESISTOR, American symbol
ROUTER = dragino:MA08-2: PIN HEADER; OC_FARNELL: unknown; OC_NEWARK: unknown
S1 = dragino:PUSH_SWITCH: PUSH SWITCH ITT-Cannon-Cannon
SIM1 = dragino-passive:SIM_CARD_CON_6
SV2 = con-lstb:MA03-2: PIN HEADER; OC_FARNELL: unknown; OC_NEWARK: unknown
T1 = dragino:RJ45_TRANSFORMER_HST2038DR
U1 = dragino:RFM92_93W
U2 U3 U9 = dragino:RT7272
U4 = dragino:HE-4025
U8 = din:ATTINY13
U10 = dragino:SMF05C
U12 = dragino:USB_HUB_FE1.1S
USB2 = dragino-passive:USB_C42562
X3 = dragino-passive:CRYSTAL

## Net classes
0 default: clearance 0.205 mm
1 2layer-50ohm: width 1 mm, clearance 0.2 mm
2 gnd: width 0.305 mm, drill 0.33 mm, clearance 0.254 mm
3 usbvcc: width 0.508 mm, drill 0.61 mm, clearance 0.254 mm
4 aref: width 0.406 mm, drill 0.61 mm, clearance 0.254 mm
6 usbtrace-4layer: width 0.191 mm, clearance 0.203 mm